# EasyEDA Pro project 智能母版V4.eprj, board PCB1
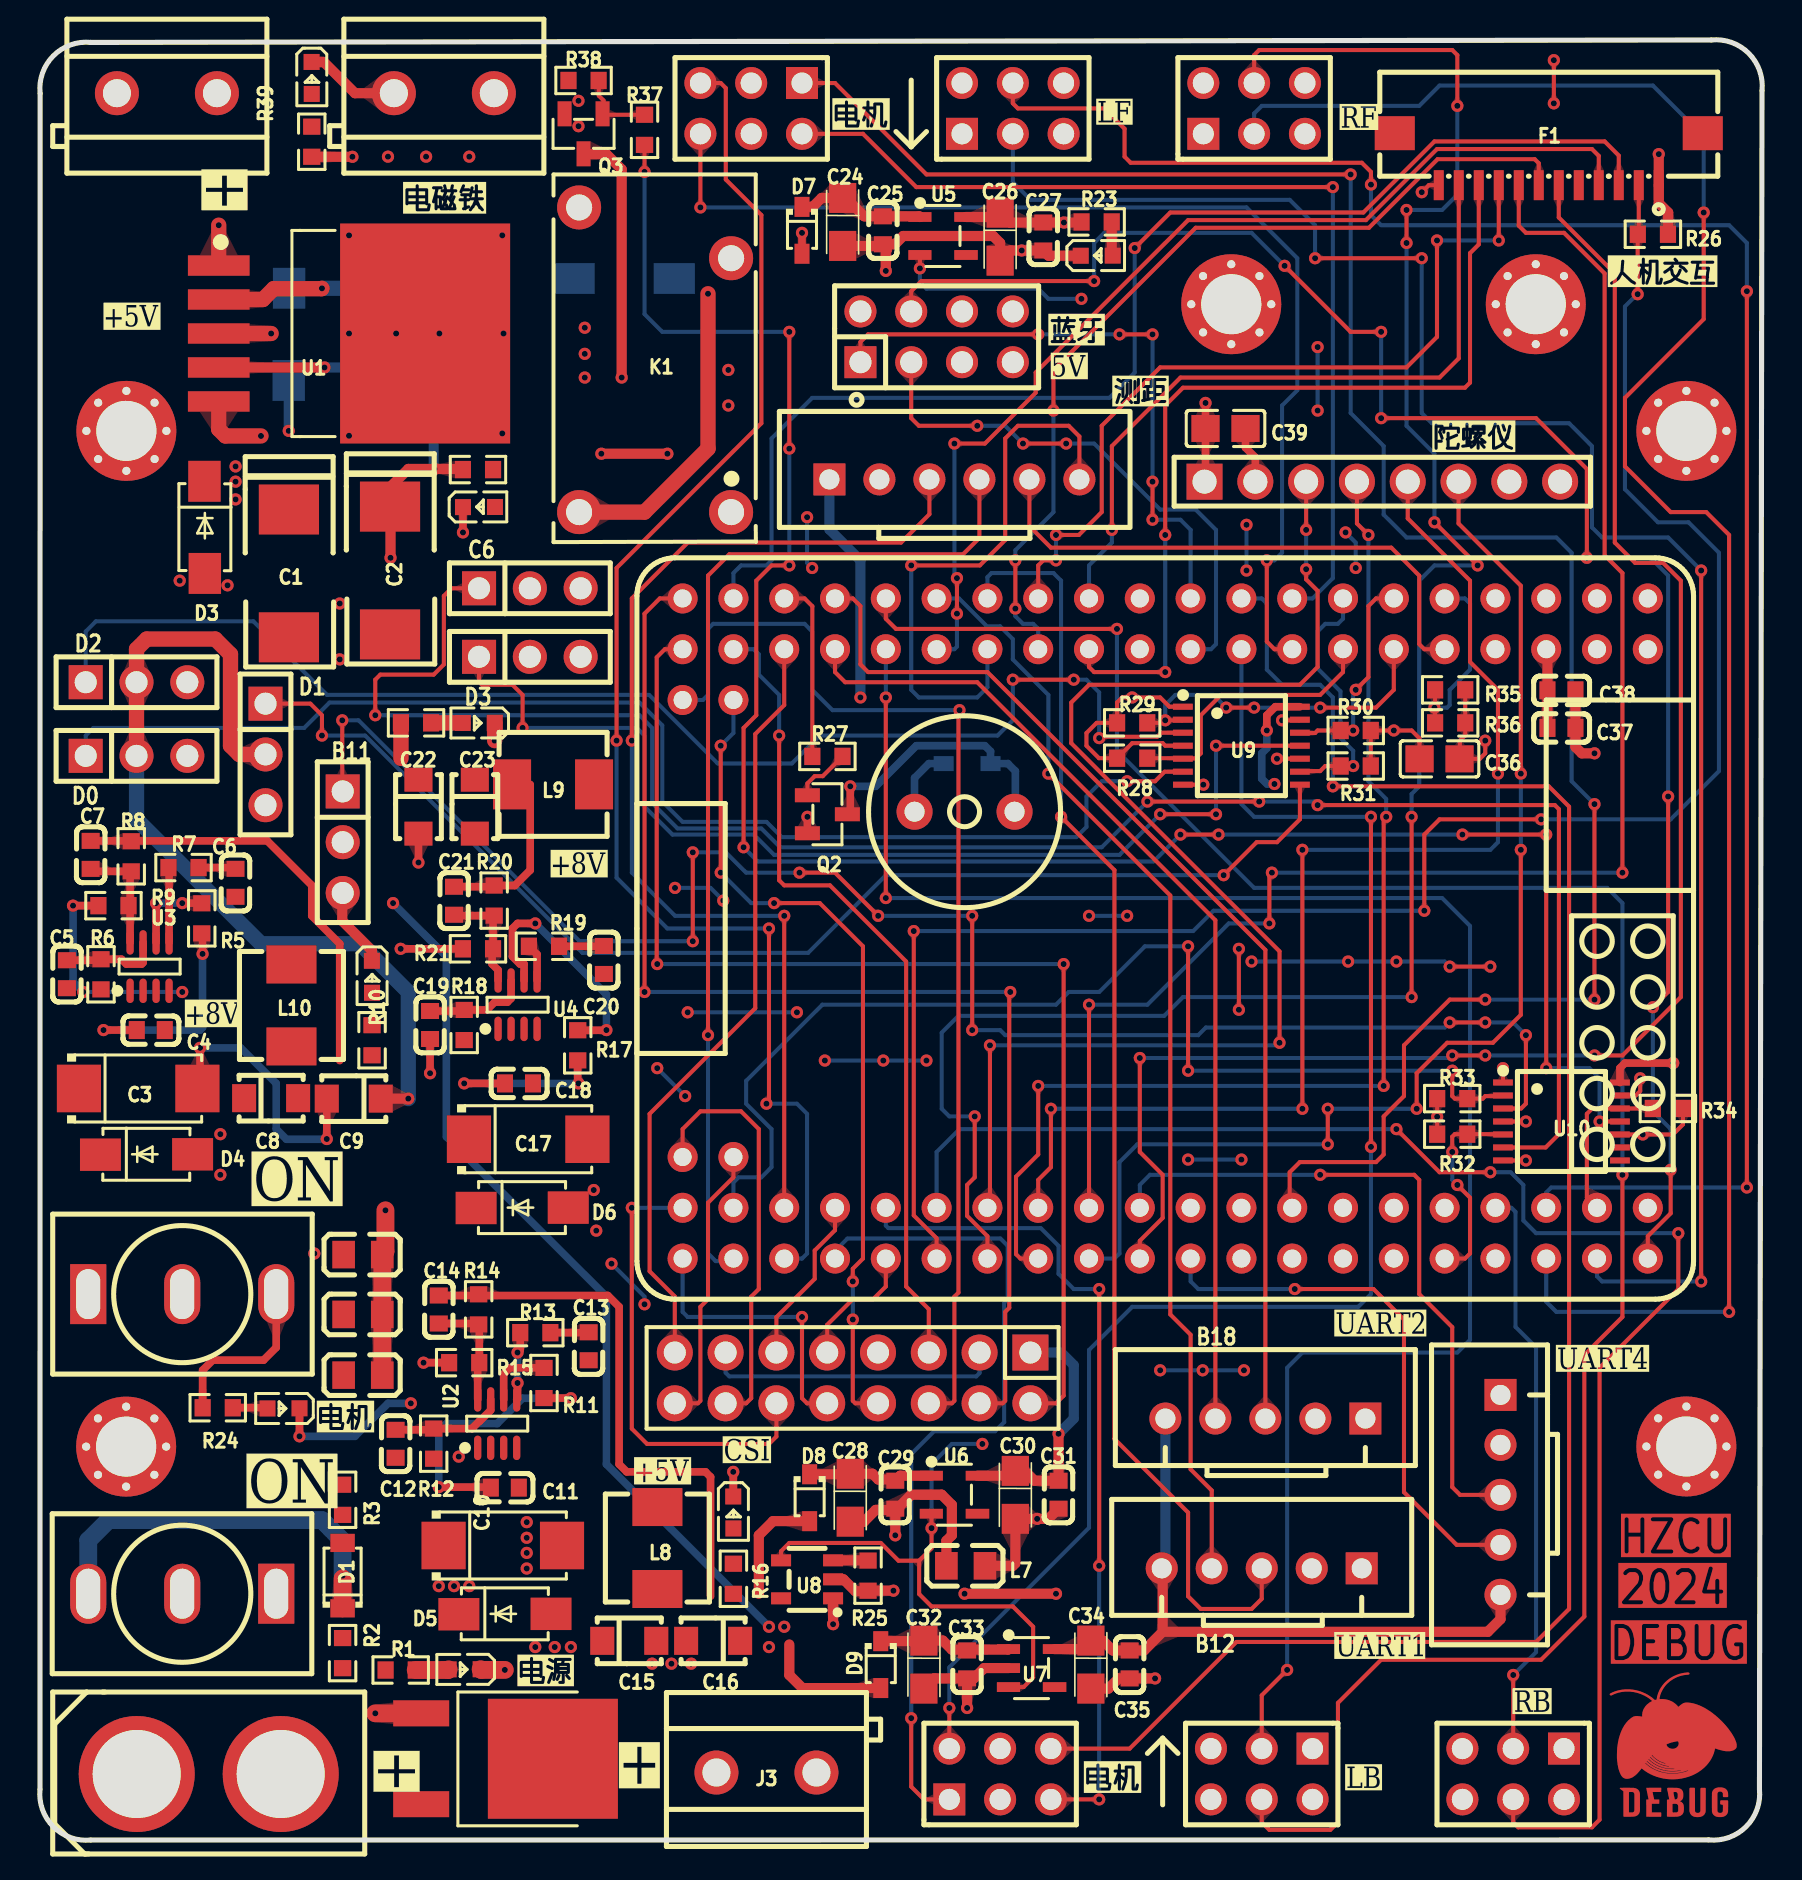
[diagram p2: board, top side]
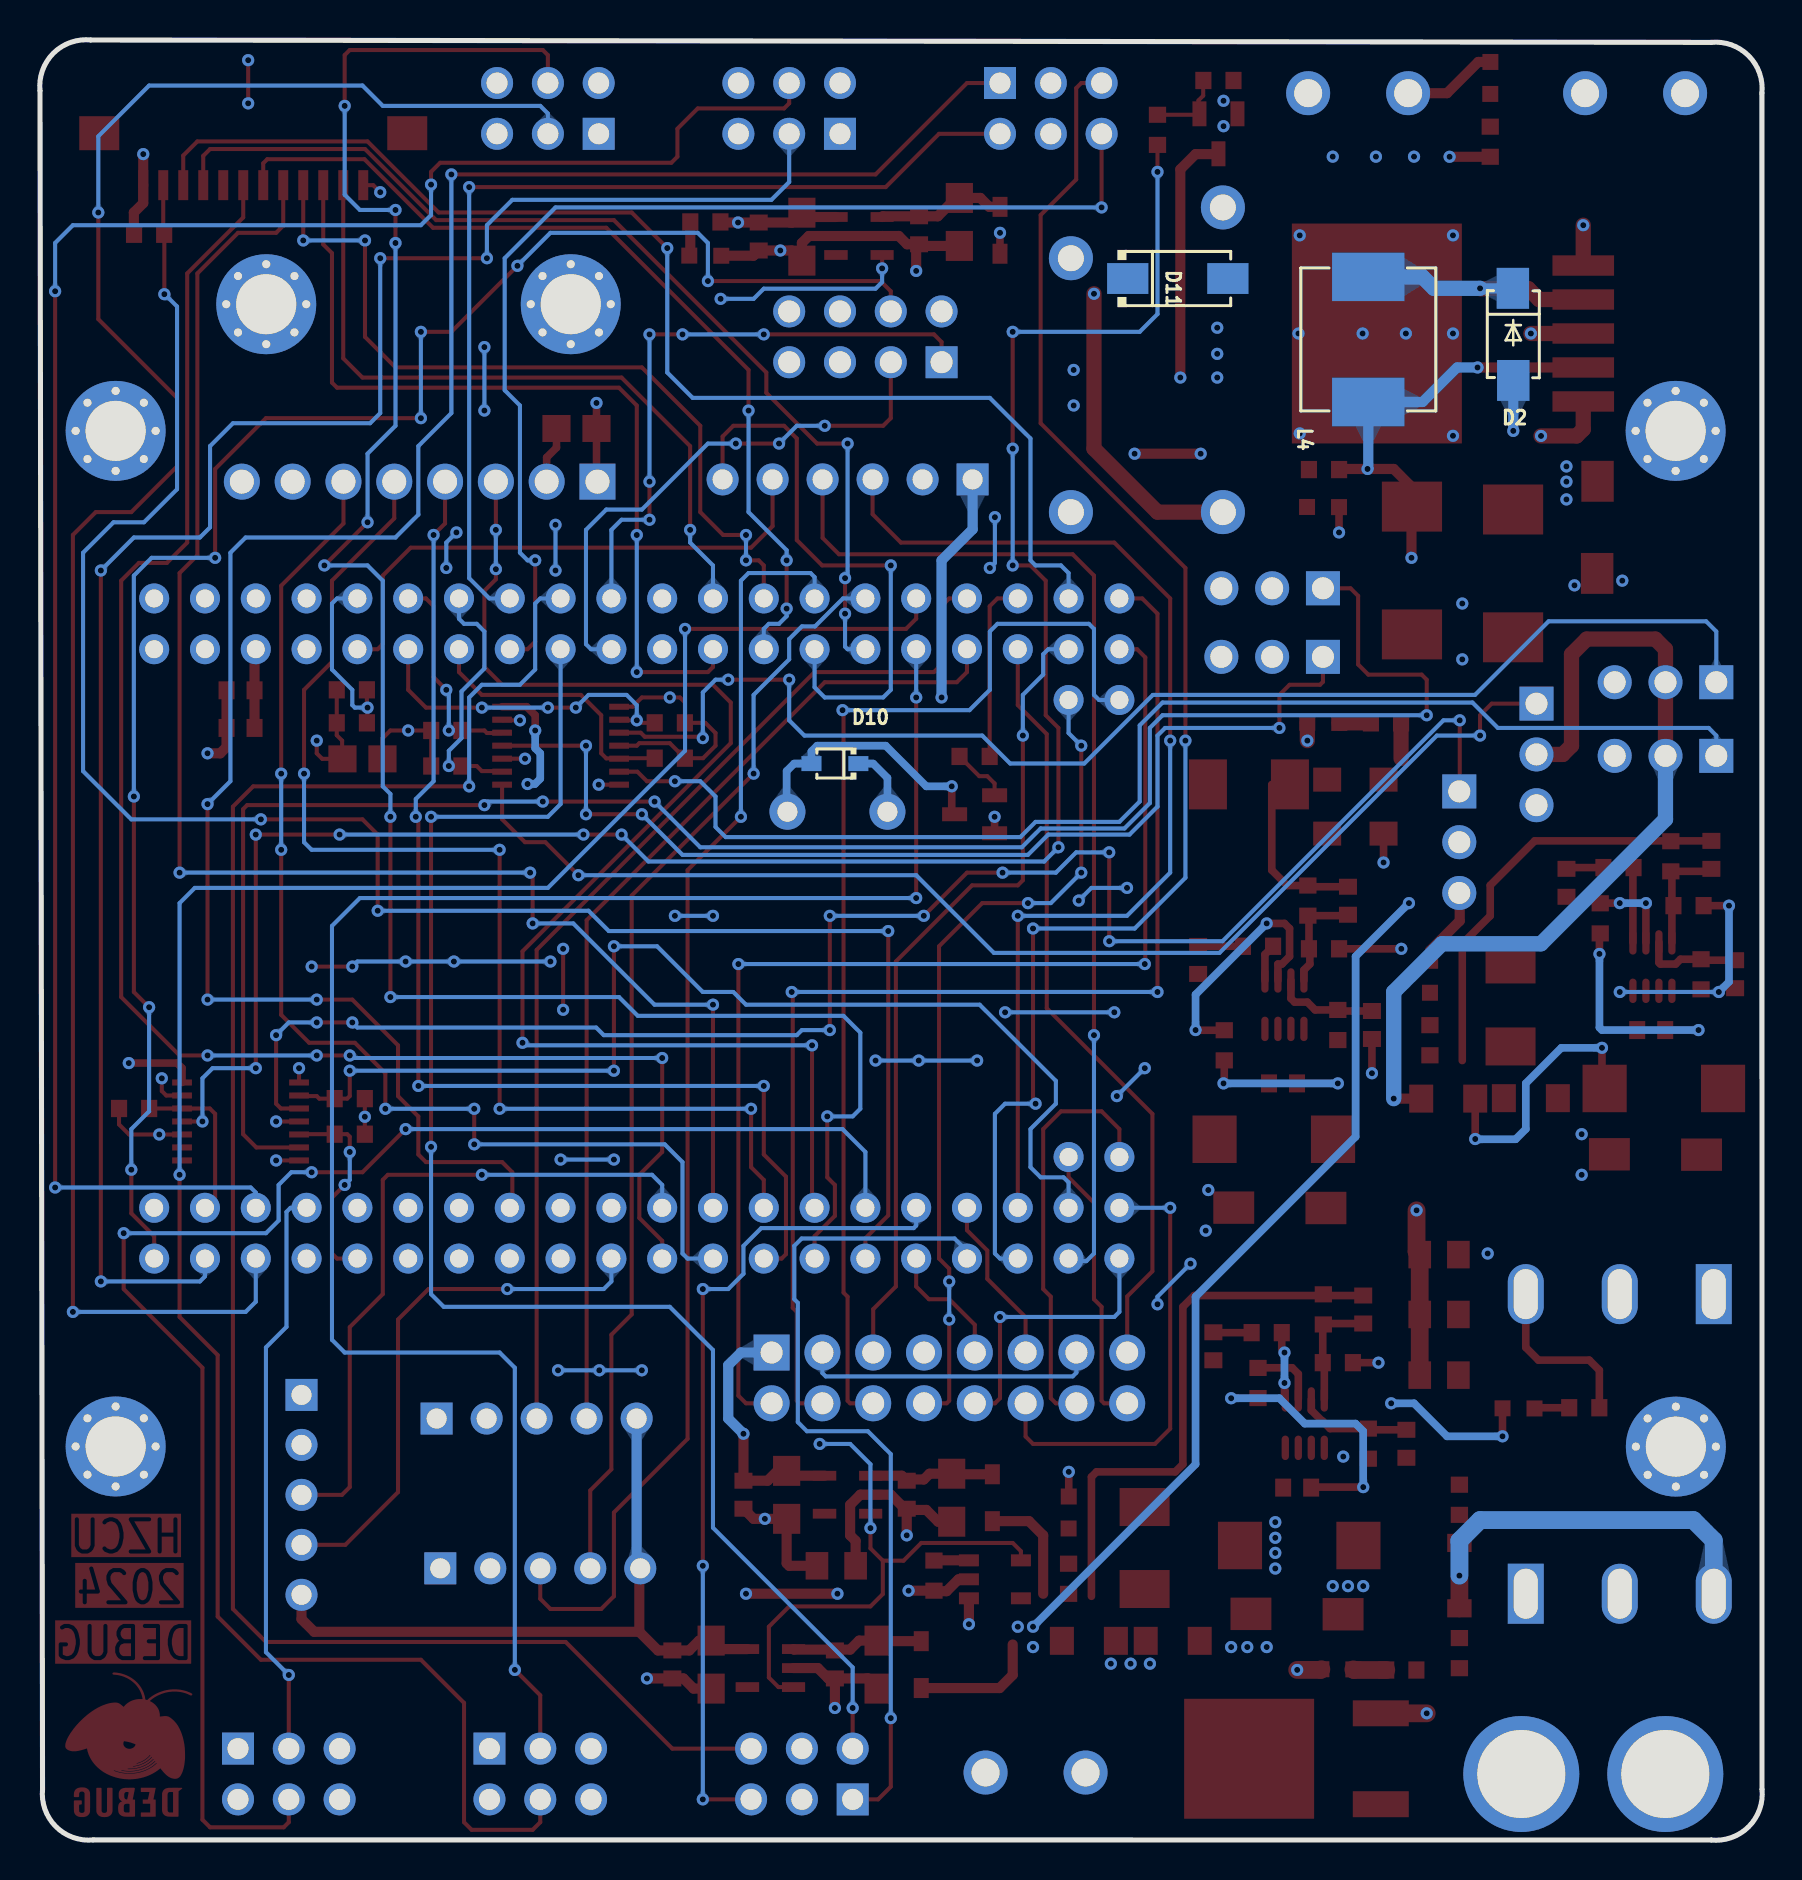
[diagram p3: board, bottom side, seen from below]

Outline 86.1 x 90.04 mm; copper layers: Top Layer, GND, PWR, Bottom Layer. Coordinates in mm from the lower left corner of the outline.
Outline path: 0,2.54 0.01,87.37 arc(0.67,89.25) 2.54,89.92 83.56,90.04 arc(85.43,89.37) 86.1,87.5 85.97,2.55 arc(85.31,0.67) 83.43,0.01 2.54,0 arc(0.67,0.67) 0,2.54
Stack: Top Layer 0.035mm 外层铜厚1oz / Dielectric1 0.2104mm 7628 RC49% 8.6mil / GND 0.0152mm 内层铜厚 / Dielectric2 1.065mm 1.1mm H/HOZ 含铜 / PWR 0.0152mm 内层铜厚 / Dielectric3 0.2104mm 7628 RC49% 8.6mil / Bottom Layer 0.035mm 外层铜厚1oz

## Design rules (mm)
template: 自定义配置
spacing copperThickness1oz (default): track to track 0.102, other pairs 0.152 to 0.3
spacing copperThickness2oz: track to track 0.203, other pairs 0.152 to 0.3
track width copperThickness1oz (default): min 0.127, default 0.254, max 2.54
track width copperThickness2oz: min 0.203, default 0.254, max 2.54
differential pair differentialPair (default): width min 0.127, default 0.254, max 2.54; gap min 0.152, default 0.152
via viaSize (default): diameter min 0.5, default 0.61, max 10; hole min 0.3, default 0.305, max 6.3

## Placement (name value [footprint] x y rotation side)
B1  M3螺柱孔_JX  [M3]  4.31 19.68 0 top
B2  M3螺柱孔_JX  [M3]  4.32 70.48 0 top
B3  M3螺柱孔_JX  [M3]  82.32 19.68 0 top
B4  M3螺柱孔_JX  [M3]  82.32 70.48 0 top
B5  M3螺柱孔_JX  [M3]  59.56 76.82 0 top
B6  M3螺柱孔_JX  [M3]  74.79 76.82 0 top
BUZZER1  3000Hz  [BUZ-TH_BD9.6-P5.00-D0.7-FD]  46.23 51.43 0 top
C1  220uF  [CASE-E_7343]  12.45 63.36 90 top
C2  220uF  [CASE-E_7343]  17.5 63.5 90 top
C3  22uF  [CAP-SMD_L6.0-W3.2-R-RD]  4.91 37.59 180 top
C4  100nF  [C0603]  5.54 40.51 180 top
C5  100nF  [C0603]  1.34 43.31 270 top
C6  100nF  [C0603]  9.78 47.88 90 top
C7  33pF  [C0603]  2.53 49.28 270 top
C8  22uF  [CAP-SMD_L3.2-W1.6]  11.56 37.11 0 top
C9  22uF  [CAP-SMD_L3.2-W1.6]  15.69 37.08 180 top
C10  22uF  [CAP-SMD_L6.0-W3.2-R-RD]  23.14 14.73 180 top
C11  100nF  [C0603]  23.24 17.63 180 top
C12  100nF  [C0603]  17.78 19.82 270 top
C13  100nF  [C0603]  27.43 24.7 90 top
C14  33pF  [C0603]  19.94 26.54 270 top
C15  22uF  [CAP-SMD_L3.2-W1.6]  29.46 9.96 0 top
C16  22uF  [CAP-SMD_L3.2-W1.6]  33.66 9.96 180 top
C17  22uF  [CAP-SMD_L6.0-W3.2-R-RD]  24.41 35.05 180 top
C18  100nF  [C0603]  23.95 37.85 180 top
C19  100nF  [C0603]  19.5 40.77 270 top
C20  100nF  [C0603]  28.19 44.02 90 top
C21  33pF  [C0603]  20.7 46.98 270 top
C22  22uF  [CAP-SMD_L3.2-W1.6]  18.92 51.69 270 top
C23  22uF  [CAP-SMD_L3.2-W1.6]  21.74 51.69 270 top
C24  10uF  [CASE-A_3216]  40.13 80.94 270 top
C25  100nF  [C0603]  42.15 80.52 90 top
C26  10uF  [CASE-A_3216]  48.01 80.2 270 top
C27  100nF  [C0603]  50.16 80.21 90 top
C28  10uF  [CASE-A_3216]  40.51 17.12 270 top
C29  100nF  [C0603]  42.76 17.27 90 top
C30  10uF  [CASE-A_3216]  48.77 17.26 270 top
C31  100nF  [C0603]  50.93 17.27 90 top
C32  10uF  [CASE-A_3216]  44.2 8.77 270 top
C33  100nF  [C0603]  46.35 8.78 90 top
C34  10uF  [CASE-A_3216]  52.54 8.77 270 top
C35  100nF  [C0603]  54.48 8.78 90 top
C36  1uF  [C0805]  69.98 54.08 0 top
C37  10uF  [C0603]  76.07 55.63 180 top
C38  100nF  [C0603]  76.07 57.51 180 top
C39  10uF  [C0805]  59.28 70.6 180 top
CN1  ZX-HA2.54-6PZZ  [CONN-TH_6P-P2.50_ZX-HA2.54-6PZZ]  45.72 68.06 0 top
CN2  XHB-5A  [XHB-TH_5PIN-V-PITCH2.50-R]  61.09 13.59 0 top
CN3  XHB-5A  [XHB-TH_5PIN-V-PITCH2.50-R]  61.27 21.08 0 top
CN4  XHB-5A  [XHB-TH_5PIN-V-PITCH2.50-R]  73.03 17.26 90 top
D1  BZT52C16  [SOD-123_L2.7-W1.6-LS3.7-RD]  15.13 13.22 90 top
D2  SS54  [SMA_L4.3-W2.6-LS5.0-FD]  12.45 75.31 90 bottom
D3  SS54  [SMA_L4.3-W2.6-LS5.0-FD]  8.23 65.66 90 top
D4  SS54  [SMA_L4.3-W2.6-LS5.0-FD]  5.33 34.29 180 top
D5  SS54  [SMA_L4.3-W2.6-LS5.0-FD]  23.25 11.3 180 top
D6  SS54  [SMA_L4.3-W2.6-LS5.0-FD]  24.11 31.62 180 top
D7  1N5819WS  [SOD-323_L1.8-W1.3-LS2.5-RD]  38.1 80.52 270 top
D8  1N5819WS  [SOD-323_L1.8-W1.3-LS2.5-RD]  38.48 17.12 270 top
D9  1N5819WS  [SOD-323_L1.8-W1.3-LS2.5-RD]  42.04 8.77 270 top
D10  1N5819WS  [SOD-323_L1.8-W1.3-LS2.5-RD]  46.35 53.84 0 bottom
D11  SS54  [SMA_L4.4-W2.8-LS5.4-R-RD]  29.21 78.1 180 bottom
F1  FPC-1.0FX-12PWCR-H20  [FPC-SMD_XUNPU_FPC-1.0FX-12PWCR-H20]  75.44 84.07 180 top
H1  -  [HDR-TH_16P-P2.54-V-F-R2-C8-S2.54-1]  40.63 23.11 180 top
H2  -  [HDR-TH_6P-P2.54-V-R2-C3-S2.54_A2541WV-2X3P]  60.71 86.61 0 top
H3  -  [HDR-TH_6P-P2.54-V-R2-C3-S2.54_A2541WV-2X3P]  48.64 86.61 0 top
H4  -  [HDR-TH_6P-P2.54-V-R2-C3-S2.54_A2541WV-2X3P]  61.09 3.3 180 top
H5  -  [HDR-TH_6P-P2.54-V-R2-C3-S2.54_A2541WV-2X3P]  73.66 3.3 180 top
H6  -  [HDR-TH_8P-P2.54-V-F-1]  67.12 67.94 0 top
H7  -  [HDR-TH_6P-P2.54-V-R2-C3-S2.54_A2541WV-2X3P]  48.01 3.3 0 top
H8  -  [HDR-TH_6P-P2.54-V-R2-C3-S2.54_A2541WV-2X3P]  35.56 86.61 180 top
H9  -  [HDR-TH_8P-P2.54-V-F-R2-C4-S2.54-1]  44.83 75.19 0 top
H10  -  [HDR-TH_3P-P2.54-V-M]  4.83 54.23 0 top
H11  -  [HDR-TH_3P-P2.54-V-M]  11.28 54.3 270 top
H12  -  [HDR-TH_3P-P2.54-V-M]  4.83 57.91 0 top
H13  -  [HDR-TH_3P-P2.54-V-M]  24.49 59.18 0 top
H14  -  [HDR-TH_3P-P2.54-V-M]  24.49 62.61 0 top
H15  -  [HDR-TH_3P-P2.54-V-M]  15.14 49.91 270 top
J1  XT60  [CONN-TH_XT60]  8.44 3.3 0 top
J2  KF301-5.0-2P  [CONN-TH_P5.00_KF301-5.0-2P]  6.35 87.38 180 top
J3  KF301-5.0-2P  [CONN-TH_P5.00_KF301-5.0-2P]  36.32 3.38 0 top
J4  KF301-5.0-2P  [CONN-TH_P5.00_KF301-5.0-2P]  20.19 87.38 180 top
K1  HF32F/012-HSL3  [RELAY-TH_HF32F-X-HXXXX-XXX]  30.76 74.04 90 top
L1  CBG201209U000T  [L0805]  16.15 29.28 0 top
L2  CBG201209U000T  [L0805]  16.15 26.29 0 top
L3  CBG201209U000T  [L0805]  16.15 23.25 0 top
L4  33uH  [IND-SMD_L7.0-W6.6_FXL0630]  19.69 75.06 90 bottom
L7  CBG201209U000T  [L0805]  46.28 13.72 0 top
L8  4.7uH  [IND-SMD_L5.4-W5.2_FXL0530]  30.87 14.6 270 top
L9  4.7uH  [IND-SMD_L5.4-W5.2_FXL0530]  25.65 52.8 180 top
L10  4.7uH  [IND-SMD_L5.4-W5.2_FXL0530]  12.57 41.74 270 top
LED1  NCD0603R1  [LED0603-RD_RED]  21.23 8.54 180 top
LED2  NCD0603R1  [LED0603-RD_RED]  21.95 66.67 0 top
LED3  NCD0603W1  [LED0603-RD]  16.6 43.18 270 top
LED4  NCD0603W1  [LED0603-RD]  34.67 16.38 270 top
LED5  NCD0603W1  [LED0603-RD]  21.94 55.88 180 top
LED6  NCD0603W1  [LED0603-RD]  52.84 79.25 0 top
LED7  NCD0603W1  [LED0603-RD]  12.17 21.59 180 top
LED8  NCD0603W1  [LED0603-RD]  13.58 88.14 270 top
Q1  NCE60P50K  [TO-252-2_L6.6-W6.1-P4.57-LS9.9-TL-CW]  22.35 4.06 0 top
Q2  SS8050  [SOT-23-3_L2.9-W1.3-P1.90-LS2.4-BR]  39.37 51.31 180 top
Q3  SS8050  [SOT-23-3_L2.9-W1.3-P1.90-LS2.4-BR]  27.18 85.34 90 top
R1  10kΩ  [R0603]  18.03 8.5 0 top
R2  4.7kΩ  [R0603]  15.13 9.35 270 top
R3  10kΩ  [R0603]  15.13 17.02 90 top
R4  10kΩ  [R0603]  21.9 68.55 0 top
R5  100kΩ  [R0603]  8.09 46.1 270 top
R6  100kΩ  [R0603]  3.05 43.3 90 top
R7  10Ω  [R0603]  7.18 48.64 0 top
R8  40.2k  [R0603]  4.56 49.21 270 top
R9  5.49k  [R0603]  3.67 46.74 0 top
R10  10kΩ  [R0603]  16.6 40 270 top
R11  100kΩ  [R0603]  25.2 22.86 270 top
R12  100kΩ  [R0603]  19.69 19.83 90 top
R13  10Ω  [R0603]  24.76 25.38 0 top
R14  40.2k  [R0603]  21.93 26.54 270 top
R15  5.49k  [R0603]  21.21 23.88 0 top
R16  10kΩ  [R0603]  34.67 13.07 270 top
R17  100kΩ  [R0603]  26.89 39.75 270 top
R18  100kΩ  [R0603]  21.21 40.77 90 top
R19  10Ω  [R0603]  25.2 44.7 0 top
R20  40.2k  [R0603]  22.71 46.99 270 top
R21  5.49k  [R0603]  21.9 44.58 0 top
R22  10kΩ  [R0603]  18.8 55.88 180 top
R23  10kΩ  [R0603]  52.83 80.94 0 top
R24  10kΩ  [R0603]  8.89 21.62 180 top
R25  4.7kΩ  [R0603]  41.4 13.22 90 top
R26  4.7kΩ  [R0603]  80.65 80.32 0 top
R27  1kΩ  [R0603]  39.37 54.2 0 top
R28  10kΩ  [R0603]  54.61 54.11 180 top
R29  10kΩ  [R0603]  54.61 55.88 180 top
R30  10kΩ  [R0603]  65.79 55.5 0 top
R31  10kΩ  [R0603]  65.79 53.72 0 top
R32  10kΩ  [R0603]  70.61 35.31 180 top
R33  10kΩ  [R0603]  70.61 37.08 180 top
R34  10kΩ  [R0603]  81.4 36.59 0 top
R35  0Ω  [R0603]  70.51 57.53 0 top
R36  10kΩ  [R0603]  70.51 55.88 0 top
R37  4.7kΩ  [R0603]  30.23 85.54 90 top
R38  4.7kΩ  [R0603]  27.18 88.01 180 top
R39  10kΩ  [R0603]  13.59 84.95 90 top
S1  MT-0-102-A101-M200-RS  [SW-TH_MT-0-103-A101-M200-RS]  7.11 12.32 180 top
S2  MT-0-102-A101-M200-RS  [SW-TH_MT-0-103-A101-M200-RS]  7.11 27.3 0 top
U1  LM2596S-5.0  [TO-263-5_L10.2-W8.9-P1.70-BR]  14.1 75.36 180 top
U2  -  [tsot-23-8_l2.9-w1.6-p0.65-ls2.8-br]  22.86 20.83 270 top
U3  -  [tsot-23-8_l2.9-w1.6-p0.65-ls2.8-br]  5.48 43.69 270 top
U4  -  [tsot-23-8_l2.9-w1.6-p0.65-ls2.8-br]  23.88 41.78 270 top
U5  RT9013-33GB  [SOT-23-5_L3.0-W1.7-P0.95-LS2.8-BL]  45.15 80.23 270 top
U6  RT9013-33GB  [SOT-23-5_L3.0-W1.7-P0.95-LS2.8-BL]  45.72 17.27 270 top
U7  RT9013-33GB  [SOT-23-5_L3.0-W1.7-P0.95-LS2.8-BL]  49.58 8.6 270 top
U8  RY2121  [SOT-23-5_L3.0-W1.6-P0.95-LS2.8-BL]  38.35 13.04 90 top
U9  SN74HC125PWR  [TSSOP-14_L5.0-W4.4-P0.65-LS6.5-BL]  60.07 54.74 270 top
U10  SN74HC125PWR  [TSSOP-14_L5.0-W4.4-P0.65-LS6.5-BL]  76.07 35.94 270 top
U11  MIMXRT1064xVL_CoreBoard  [MIMXRT1064xVL_CoreBoard - 3D]  56.26 45.59 180 top

## Footprints (pads in the part's own frame, mm; a bottom-side part is the same pattern mirrored in y, then rotated)
BUZ-TH_BD9.6-P5.00-D0.7-FD
  round 1.8 hole 1: 1(-2.5,0) 2(2.5,0)
C0603
  rect 0.8x0.9 smd: 1(-0.7,0) 2(0.7,0)
C0805
  rect 1.41x1.35 smd: 1(-1,0) 2(1,0)
CAP-SMD_L3.2-W1.6
  rect 1.2x1.4 smd: 1(-1.35,0) 2(1.35,0)
CAP-SMD_L6.0-W3.2-R-RD
  rect 2.208x2.376 smd: 1(2.961,0) 2(-2.961,0)
CASE-A_3216
  rect 1.5x1.359 smd: 1(-1.2,0) 2(1.2,0)
CASE-E_7343
  rect 2.5x3.01 smd: 1(3.196,0) 2(-3.196,0)
CONN-TH_6P-P2.50_ZX-HA2.54-6PZZ
  rect 1.6x1.6 hole 1: 1(-6.25,0)
  round 1.6 hole 1: 2(-3.75,0) 3(-1.25,0) 4(1.25,0) 5(3.75,0) 6(6.25,0)
CONN-TH_P5.00_KF301-5.0-2P
  round 2.2 hole 1.4: 1(-2.5,0) 2(2.5,0)
CONN-TH_XT60
  round 5.8 hole 4.4: 1(-3.6,0) 2(3.6,0)
FPC-SMD_XUNPU_FPC-1.0FX-12PWCR-H20
  rect 0.5x1.5 smd: 1(-5.5,1.3) 2(-4.5,1.3) 3(-3.5,1.3) 4(-2.5,1.3) 5(-1.5,1.3) 6(-0.5,1.3) 7(0.5,1.3) 8(1.5,1.3) 9(2.5,1.3) 10(3.5,1.3) 11(4.5,1.3) 12(5.5,1.3)
  rect 2x1.7 smd: 13(7.7,-1.3) 14(-7.7,-1.3)
HDR-TH_3P-P2.54-V-M
  rect 1.7x1.7 hole 1.1: 1(-2.54,0)
  round 1.7 hole 1.1: 2(0,0) 3(2.54,0)
HDR-TH_6P-P2.54-V-R2-C3-S2.54_A2541WV-2X3P
  rect 1.6x1.6 hole 1.05: 1(-2.54,-1.27)
  round 1.6 hole 1.05: 2(-2.54,1.27) 3(0,-1.27) 4(0,1.27) 5(2.54,-1.27) 6(2.54,1.27)
HDR-TH_8P-P2.54-V-F-1
  rect 1.8x1.8 hole 1.2: 1(-8.89,0)
  round 1.8 hole 1.2: 2(-6.35,0) 3(-3.81,0) 4(-1.27,0) 5(1.27,0) 6(3.81,0) 7(6.35,0) 8(8.89,0)
HDR-TH_8P-P2.54-V-F-R2-C4-S2.54-1
  rect 1.6x1.6 hole 1.1: 1(-3.81,-1.27)
  round 1.6 hole 1.1: 2(-3.81,1.27) 3(-1.27,-1.27) 4(-1.27,1.27) 5(1.27,-1.27) 6(1.27,1.27) 7(3.81,-1.27) 8(3.81,1.27)
HDR-TH_16P-P2.54-V-F-R2-C8-S2.54-1
  rect 1.8x1.8 hole 1.1: 1(-8.89,-1.27)
  round 1.8 hole 1.1: 2(-8.89,1.27) 3(-6.35,-1.27) 4(-6.35,1.27) 5(-3.81,-1.27) 6(-3.81,1.27) 7(-1.27,-1.27) 8(-1.27,1.27) 9(1.27,-1.27) 10(1.27,1.27) 11(3.81,-1.27) 12(3.81,1.27) 13(6.35,-1.27) 14(6.35,1.27) 15(8.89,-1.27) 16(8.89,1.27)
IND-SMD_L5.4-W5.2_FXL0530
  rect 1.9x2.5 smd: 1(-2.05,0) 2(2.05,0)
IND-SMD_L7.0-W6.6_FXL0630
  rect 2.424x3.62 smd: 1(3.128,0) 2(-3.128,0)
L0805
  rect 1.133x1.377 smd: 1(-0.966,0) 2(0.966,0)
LED0603-RD
  rect 0.8x0.8 smd: 1(-0.799,-0.004) 2(0.799,0.004)
LED0603-RD_RED
  rect 0.8x0.8 smd: 1(-0.799,-0.004) 2(0.799,0.004)
M3
  round 0.6 hole 0.405x0.4: 1(-2,0) 1(-1.41,1.409) 1(-1.41,-1.41) 1(0,2) 1(0,-2) 1(1.41,1.409) 1(1.41,-1.41) 1(2,0)
  round 5 hole 3.005x3: 1(0,0)
MIMXRT1064xVL_CoreBoard - 3D
  round 1.5 hole 0.9: 1(-24.13,-16.51) 2(-24.13,-13.97) 3(-21.59,-16.51) 4(-21.59,-13.97) 5(-19.05,-16.51) 6(-19.05,-13.97) 7(-16.51,-16.51) 8(-16.51,-13.97) 9(-13.97,-16.51) 10(-13.97,-13.97) 11(-11.43,-16.51) 12(-11.43,-13.97) 13(-8.89,-16.51) 14(-8.89,-13.97) 15(-6.35,-16.51) 16(-6.35,-13.97) 17(-3.81,-16.51) 18(-3.81,-13.97) 19(-1.27,-16.51) 20(-1.27,-13.97) 21(1.27,-16.51) 22(1.27,-13.97) 23(3.81,-16.51) 24(3.81,-13.97) 25(6.35,-16.51) 26(6.35,-13.97) 27(8.89,-16.51) 28(8.89,-13.97) 29(11.43,-16.51) 30(11.43,-13.97) 31(13.97,-16.51) 32(13.97,-13.97) 33(16.51,-16.51) 34(16.51,-13.97) 35(19.05,-16.51) 36(19.05,-13.97) 37(21.59,-16.51) 38(21.59,-13.97) 39(24.13,-16.51) 40(24.13,-13.97) 41(21.59,-11.43) 42(24.13,-11.43) 43(24.13,11.43) 44(21.59,11.43) 45(24.13,13.97) 46(24.13,16.51) 47(21.59,13.97) 48(21.59,16.51) 49(19.05,13.97) 50(19.05,16.51) 51(16.51,13.97) 52(16.51,16.51) 53(13.97,13.97) 54(13.97,16.51) 55(11.43,13.97) 56(11.43,16.51) 57(8.89,13.97) 58(8.89,16.51) 59(6.35,13.97) 60(6.35,16.51) 61(3.81,13.97) 62(3.81,16.51) 63(1.27,13.97) 64(1.27,16.51) 65(-1.27,13.97) 66(-1.27,16.51) 67(-3.81,13.97) 68(-3.81,16.51) 69(-6.35,13.97) 70(-6.35,16.51) 71(-8.89,13.97) 72(-8.89,16.51) 73(-11.43,13.97) 74(-11.43,16.51) 75(-13.97,13.97) 76(-13.97,16.51) 77(-16.51,13.97) 78(-16.51,16.51) 79(-19.05,13.97) 80(-19.05,16.51) 81(-21.59,13.97) 82(-21.59,16.51) 83(-24.13,13.97) 84(-24.13,16.51)
R0603
  rect 0.806x0.864 smd: 1(-0.753,0) 2(0.753,0)
RELAY-TH_HF32F-X-HXXXX-XXX
  round 2.2 hole 1.3: 1(-7.62,-3.8) 2(-7.62,3.8) 3(7.62,3.8) 4(5.08,-3.8)
SMA_L4.3-W2.6-LS5.0-FD
  rect 2.046x1.62 smd: 1(-2.304,-0.009) 2(2.304,0.009)
SMA_L4.4-W2.8-LS5.4-R-RD
  rect 2.062x1.539 smd: 1(2.503,0) 2(-2.503,0)
SOD-123_L2.7-W1.6-LS3.7-RD
  rect 0.91x1.22 smd: 1(-1.635,0) 2(1.635,0)
SOD-323_L1.8-W1.3-LS2.5-RD
  rect 1x0.75 smd: 1(-1.173,0) 2(1.173,0)
SOT-23-3_L2.9-W1.3-P1.90-LS2.4-BR
  rect 1.25x0.7 smd: 1(1,-0.95) 2(1,0.95) 3(-1,0)
SOT-23-5_L3.0-W1.6-P0.95-LS2.8-BL
  rect 0.6x1 smd: 1(-0.95,-1.3) 2(0,-1.3) 3(0.95,-1.3) 4(0.95,1.3) 5(-0.95,1.3)
SOT-23-5_L3.0-W1.7-P0.95-LS2.8-BL
  rect 0.49x1.157 smd: 1(-0.95,-1.153) 2(0,-1.153) 3(0.95,-1.153)
  rect 0.49x1.175 smd: 4(0.95,1.153) 5(-0.95,1.153)
SW-TH_MT-0-103-A101-M200-RS
  rect 1.8x3 hole 1.2x2.5: 1(-4.7,0)
  oval 1.8x3 hole 1.2x2.5: 2(0,0) 3(4.7,0)
TO-252-2_L6.6-W6.1-P4.57-LS9.9-TL-CW
  rect 2.8x1.3 smd: 1(-3.292,2.273) 3(-3.292,-2.273)
  rect 6.5x6 smd: 2(3.292,0)
TO-263-5_L10.2-W8.9-P1.70-BR
  rect 3.083x1.02 smd: 1(5.16,-3.4) 2(5.16,-1.7) 3(5.16,0) 4(5.16,1.7) 5(5.16,3.4)
  rect 8.5x11 smd: 6(-5.16,0)
tsot-23-8_l2.9-w1.6-p0.65-ls2.8-br
  oval 1.222x0.364 smd: 1(1.211,-0.975) 2(1.211,-0.325) 3(1.211,0.325) 4(1.211,0.975) 5(-1.211,0.975) 6(-1.211,0.325) 7(-1.211,-0.325) 8(-1.211,-0.975)
TSSOP-14_L5.0-W4.4-P0.65-LS6.5-BL
  rect 0.305x0.991 smd: 1(-1.95,-2.925) 2(-1.3,-2.925) 3(-0.65,-2.925) 4(0,-2.925) 5(0.65,-2.925) 6(1.3,-2.925) 7(1.95,-2.925) 8(1.95,2.925) 9(1.3,2.925) 10(0.65,2.925) 11(0,2.925) 12(-0.65,2.925) 13(-1.3,2.925) 14(-1.95,2.925)
XHB-TH_5PIN-V-PITCH2.50-R
  rect 1.6x1.6 hole 1: 1(5,0)
  round 1.6 hole 1: 2(2.5,0) 3(0,0) 4(-2.5,0) 5(-5,0)

## Nets
As in the schematic.

Pads without a net: B1 1; B2 1; B3 1; B4 1; B5 1; B6 1; F1 5 13 14; H1 7; H2 5 6; H3 5 6; H4 5 6; H5 5 6; H6 7 8; H9 2 8; S2 1; U5 4; U6 4; U7 4; U10 8 9; U11 3 4 7 8 21 22 65 67 68 70 71 72 73 74 75 78 83

## Via types
v1: diameter 0.61, hole 0.305, Top Layer to Bottom Layer, 338 vias

## Routing (per net, layer and track width the routed paths; a pad name or vN(x,y) marks a point on that pad's centre or on a via; arc(x,y) is an arc through that point)
3V3: length 220.5
  Top Layer w0.381: U9.14 61.77,56.69 61.34,56.26 v1(61.34,55.5) ; v1(81.66,38.86) 79.25,38.86 79,38.61 U10.14 ; v1(58.28,71.88) C39.2 58.28,67.99 58.23,67.94
  Top Layer w0.508: U5.5 47.79,81.18 C26.1 48.5,80.91 C27.2 v1(51.2,80.91) 52.05,80.91 R23.1 ; v1(80.94,84.33) F1.1 80.94,81.88 81.41,81.41 81.41,80.33 R26.2
  PWR w0.381: 76.51,53.09 78.36,53.09 78.99,53.72 78.99,72.9 80.94,74.84 v1(80.94,84.33) ; 76.51,53.09 75.82,53.09 74.42,51.69 70.1,51.69 68.83,50.42 62.87,50.42 61.72,51.56 v1(61.72,52.82) ; 76.51,53.09 76.45,53.03 76.45,41.15 77.6,40 81.41,40 81.66,39.75 v1(81.66,38.86) 83.19,37.34 83.19,29.46 81.41,27.69 81.41,27.18 77.85,23.62 77.85,2.29 77.6,2.03 H5.2 75.06,3.17 68.45,3.17 67.31,2.03 63.63,2.03 ; v1(51.2,80.91) 51.2,74.28 53.59,71.88 v1(58.28,71.88)
  PWR w0.508: H3.2 46.1,88.9 46.48,89.28 57.78,89.28 58.17,88.9 H2.2 55.37,87.88 53.59,86.11 53.59,84.84 51.18,82.42 51.18,80.92 v1(51.2,80.91) 61.09,80.91 64.52,84.33 v1(80.94,84.33)
  Bottom Layer w0.381: v1(61.72,52.82) 61.35,52.82 61.09,53.09 61.09,54.36 61.34,54.61 v1(61.34,55.5)
3V3_CSI: length 12.9
  Top Layer w0.508: v1(50.93,20.32) C31.2 49.72,17.97 49.23,18.46 C30.1 48.53,18.22 U6.5
  Bottom Layer w0.508: H1.1 51.05,24.38 51.69,23.75 51.69,21.08 v1(50.93,20.32)
3V3_TFT: length 92.1
  Top Layer w0.508: CN4.5 73.03,11.05 72.39,10.41 56.13,10.41 ; 56.13,10.41 56.13,13.54 CN2.5 ; 56.13,10.41 55.2,9.48 C35.2 53.64,9.48 53.15,9.97 C34.1 52.12,9.55 U7.5
  PWR w0.508: CN3.5 56.27,19.56 54.23,17.53 46.74,17.53 44.58,19.68 29.97,19.68 28.96,20.7 16.64,20.7 15.37,21.97 10.41,21.97 7.11,25.27 S2.2
  Bottom Layer w0.508: CN3.5 56.27,13.77 CN2.5
+5V: length 151.1
  Top Layer w0.381: D7.2 v1(38.1,80.39) ; 21.87,27.24 R14.1 ; 21.87,27.24 28.39,27.24 28.96,26.67 28.96,18.8 29.34,18.41 33.27,18.41 33.53,18.16 33.53,12.19 ; 21.87,27.24 C14.1
  Top Layer w0.508: D8.2 36.65,15.95 35.94,15.24 35.94,12.32 ; D9.2 38.12,7.6 37.47,8.25 37.47,9.78
  PWR w0.381: v1(38.1,80.39) 38.1,81.03 39.88,82.8 39.88,85.85 39.12,86.61 30.99,86.61 28.83,84.45 26.29,84.45 24.76,82.93 24.76,73.91 23.24,72.39 18.03,72.39 16.76,71.12 16.76,63.12 17.65,62.23 v1(17.65,46.86)
  Bottom Layer w0.381: v1(17.65,46.86) 20.32,44.2 20.32,35.18 28.32,27.18 28.32,18.8 v1(36.45,10.67)
  vias: v1(36.45,9.65) v1(37.21,10.67)
+5V_CORE: length 96.4
  Top Layer w0.508: v1(17.53,64.13) 17.53,67.69 18.41,68.58 v1(19.72,68.58) 21.11,68.58 R4.1 ; U11.6 75.37,59.5 75.37,55.63 ; U1.4 v1(14.22,73.66) ; v1(28.07,69.34) v1(31.37,69.34)
  PWR w0.508: v1(17.53,64.13) 21.72,64.13 26.92,69.34 v1(28.07,69.34) ; v1(31.37,69.34) 35.69,69.34 36.58,68.45 36.58,65.79 37.21,65.15 48.9,65.15 49.91,66.17 51.69,66.17 54.1,63.75 59.56,63.75 60.71,64.9 62.23,64.9 62.74,64.39 70.61,64.39 70.87,64.64 74.42,64.64 75.31,63.75 U11.6
  Bottom Layer w0.508: v1(14.22,73.66) 15.24,73.66 16.97,71.93 L4.2 19.69,68.62 v1(19.72,68.58)
+5V_EXT: length 129.5
  Top Layer w0.508: U8.1 v1(39.65,10.79) ; v1(46.23,12.32) v1(50.8,12.32)
  PWR w0.381: H9.7 48.64,72.14 48.39,71.88 40.77,71.88 39.47,70.58 CN1.1
  PWR w0.508: v1(50.8,12.32) 54.1,12.32 55.25,11.18 65.79,11.18 66.17,11.56 66.17,13.51 CN2.1 66.27,13.77 CN3.1 ; CN3.1 66.42,21.23 66.42,32.89 65.66,33.65 65.66,41.27 63.75,43.18 54.1,43.18 48.26,49.02 44.7,49.02 43.73,50 BUZZER1.1 43.73,53.05 41.02,55.75 v1(41.02,57.15) ; CN3.1 67.94,21.08 69.22,22.35 72.94,22.35 CN4.1 ; v1(39.65,10.79) 44.7,10.79 v1(46.23,12.32)
  Bottom Layer w0.381: BUZZER1.1 43.73,53.13 44.44,53.84 D10.1
  Bottom Layer w0.508: v1(41.02,57.15) 41.02,64.01 39.47,65.56 CN1.1
+8V_1: length 65.5
  Top Layer w0.381: 14.99,38.99 14.99,44.83 13.59,46.23 13.59,47.75 11.36,49.98 4.54,49.98 ; 4.54,49.98 R8.1 ; 4.54,49.98 C7.1